# EAGLE board Mk4 Prototype (EAGLE 9.0.1), part 2 of 2
## Tracks (layer width: path | path; a pad name or v marks a point on that pad's centre or on a via) (continued)
GND  (via drill 0.3) (continued)
  Bottom 0.15: J2.32 56.55,38.25 | J2.31 57.05,38 | J2.30 57.55,38 | J2.29 58.05,38 | J2.28 58.55,38 | J2.27 59.05,38 | J2.26 59.55,38 | J2.25 60.05,38 | J2.24 60.55,38 | J2.23 61.05,38 | J2.22 61.55,38 | J2.21 62.05,38 | J2.20 62.55,38 | J2.19 63.05,38 | J2.18 63.55,38 | J2.17 64.05,38 | J2.16 64.55,38 | J2.15 65.05,38 | J2.14 65.55,38 | J2.13 66.05,38 | J2.12 66.55,38 | J2.11 67.05,38 | IC1.58 v53.4,56.8 | IC1.55 v53.4,55.6 | IC7.3 70.3,70.45 v70.5,70.65 | ANT2.3 106.59,69.4 v105.95,69.4 | v105.5,68.25 105.6,68.15 105.74,68.15 105.64,68.25 v105.5,68.25 | ANT2.2 105.85,67.9 v105.5,68.25 | ANT2.4 110.08,67.7 v110.55,67.7 | IC15.PAD v17.9,23.1 | IC15.PAD v16.7,23.1 | IC15.PAD v16.7,21.9 | IC15.PAD v17.9,21.9 | v16.7,24.3 17.3,24.9 v17.3,25.85 | v16.1,25.85 16.1,24.9 v15.5,24.3 15.55,24.35 | v19.1,24.3 19.1,25.35 v19.6,25.85 | v75.3,18.75 C102.2 76.05,19.5 76.3,19.75 76.3,20.75 76.05,21 U2.2 75.05,21 74.55,20.5 U2.4 | C104.2 83.3,8.7 v83.55,8.45
  Bottom 0.2: C13.1 62.4,43.85 IC1.10 | IC1.17 59.6,43.8 C12.1 v59.3,42.75 | IC1.48 50.85,52.8 C10.1 | IC1.114 68.95,52.4 C9.1 | IC1.80 59.6,62.05 59.77,62.23 | X4.4 7.67,21.43 v7.6,21.5 | X4.2 9.52,17.07 v9.6,17 | IC4.23 75.52,26.75 75.03,27.23 75.05,27.25 | 75.05,27.25 v75.05,27.5 | IC4.24 75.05,27.25 | IC4.18 76.8,23.25 v76.55,23 | IC4.9 v81.05,26.25 | IC8.17 40.3,21.5 v39.8,21 IC8.18 | J1.GND4 110.8,16.05
  Bottom 0.25: J2.50 47.55,37.45 v48.05,37.95 | J2.49 v48.05,37.95 | J2.48 48.55,37.45 v48.05,37.95 | J2.43 51.05,38 | J2.6 v69.55,35.5 | v61.8,40.75 61.8,41.62 C14.1 62.05,42.12 C13.1 | v49.8,53.1 C10.1 | v70.05,52.75 C9.1 | v59.8,63 C11.1 59.77,62.23 | C8.1 v61.55,64.25 | v48.55,57.25 R3.2 | C15.1 v59.55,64.25 | v69.3,8.25 S19.1 | v45.3,8.25 S20.1 | C19.1 v56.5,63 | C18.1 v51.9,63 | v65.3,65.25 C17.1 | v60.8,65.25 C16.1 | v61.05,68.75 61.97,68.75 X2.2 | v65.05,66.5 64.08,66.5 X2.4 | v26.05,30 C87.2 27.2,31.1 v27.3,31 | R71.2 v18.3,15 | v25,49 IC13.PAD v25.55,49.45 | C46.2 32.67,15.22
  Bottom 0.3: 71.25,71.8 v71.95,71.1 | v25.8,27 R70.2 | v8.05,30.25 C60.1 | v10.3,31 10.42,30.88 C86.2 | v90.3,43.25 C69.2 | v89.3,43.25 C66.2 | v90.3,49.75 C65.2 | C67.2 v89.3,49.75 | IC5.8 93.9,42.65 v94.05,42.5 | R40.2 v88.55,40.25 | R38.2 v88.55,34.25 | R39.2 v88.55,36.25 | IC5.13 95.9,48.65 v96.05,48.5 | IC5.21 104.7,48.65 v104.55,48.5 | Q1.2 88.45,30.15 R30.2 v87.55,30 | IC11.4 81.7,58.34 C78.1 v81.3,59.5 | v85.8,60 85.71,60.09 JP4.5 | C71.1 v95.8,61.5 | IC12.7 86.99,49.81 R55.1 v87.05,49 | v95.3,53 C50.1 | v98.8,54 98.3,53.5 C49.1 | C48.1 v101.3,54 | J1.GND3 105.3,25.77 v105.3,25 | 117.17,28.5 J1.GND2 117.3,29 v117.8,29.5 | 117.97,26 J1.C4 117.3,25.45 v117.3,25 | v118.3,17 118.17,17 J1.GND1 | v62.95,71.1 62.97,71.12 C20.1 | R7.2 65.3,70.45 v65.2,70.35 | C1.2 v59.8,70.55 | v101.05,16.75 R59.2 101.05,15.07 Q2.2 | IC5.31 109.7,37.15 v109.8,37.25 | C51.1 v114.55,13.5 | J1.C5 110.65,17.65 v110.8,17.5 110.8,16.05 | v102.8,17.5 103.03,17.27 104.05,17.27 J1.GND6 | v112.55,29.25 112.8,29.5 IC10.3 | C2.1 v70.05,47 | C7.1 v72.8,50.25 | C6.1 v72.8,51.5 | C70.1 v76.8,48.75 | Q8.4 Q8.EP2 | C28.1 v46.8,42.25 | IC2.28 32.37,42.25 v33.3,42.25 | C24.1 v29.3,54.25 | IC2.46 33.5,56.7 v33.55,56.75 | C27.1 v29.3,59 | IC2.54 33.4,63.1 v33.55,63.25 | IC2.52 v33.55,61.5 | C26.1 v46.05,63.75 | C22.1 v46.8,61.5 | IC2.6 42.7,59.1 v42.55,59.25 | C23.1 v46.8,56.75 | C25.1 v46.8,52.75 | IC2.41 33.6,52.7 v33.8,52.5 | R15.1 v46.8,23.25 | R17.2 v46.8,24.25 | R19.2 42.3,29.5 v42.55,29.75 | v25.8,40 C42.1 | v26.55,40 26.55,39.5 C42.1 | v25.05,40 25.05,39.5 C42.1 | IC2.12 42.6,54.3 v42.55,54.25 | R63.2 v7.8,35.45 | R64.2 v8.8,35.45 | J1.GND5 110.91,27.89 v111.3,27.5 | R51.2 v78.8,48.5 | v26.05,54 C58.2 | v102.55,48.5 102.5,48.55 IC5.19 102.5,51.2 v102.55,51.25
  Bottom 0.3: R61.2 29.75,15.5 v30,15.75 | IC4.25 v77.3,26
  Bottom 0.4: C89.2 21.9,28.5 v22.25,28.85 | v25.05,27.5 C61.2 | v25.8,25.75 C95.2 | C84.2 21.92,33.62 v22.05,33.5 | C84.2 v21.05,34.75 | v19.8,34.75 C85.2 C84.2 | C90.2 16.7,30.9 v17.3,31.5 17.2,31.4 | C88.2 v14.8,31.1 | v13.3,31.4 13.9,30.8 C44.2 | v28.3,22.25 C100.1 | v28.3,23.25 C101.1 | v26.05,18.75 C96.2 | C92.2 v23.8,21 | C59.1 v14.05,37.25 | C98.1 v10.75,21.5 | C94.2 v10.05,22.25 | C62.2 v10.05,23.25 | C99.1 v10.75,17 | R62.2 v11.8,15.5 | R65.2 v12.8,15.5 | R72.2 v13.8,13.75 | C97.2 v16.8,13.75 | C91.2 v15.8,13.75 | v26.3,28.75 C93.2 25.2,29.9 v25.3,30 | IC14.4 7.2,42.16 v7.05,42 | v26.05,16.75 R25.2 | v73.3,26.5 C21.1 | v38.05,18.5 38.65,18.5 C40.2 38.65,19.5 v38.05,19.5 | S18.2 59.2,9 v60.05,9 | Q8.EP2 74.2,37.35 v74.3,37.25 | v74.3,41.25 v74.3,41.24 IC6.4 | C41.2 36.67,29.62 v36.55,29.75 | C41.2 v35.55,28.75 | C41.2 35.67,29.75 v35.55,29.75 | C36.2 35.4,27.4 v35.3,27.5 | v34.05,24.25 C39.1 | 0.8,21.6 v0.8,21.75 ANT1.4 | ANT1.3 v0.8,16.75 | ANT1.2 2.05,17.7 v2.05,16.75 | C43.1 v26.05,13 | C43.1 25.55,13.75 v26.05,13.75 | C43.1 25.55,12.25 v26.05,12.25
  Bottom 0.5: v12.15,36.05 12.15,35.5 C63.2 11.15,35.5 v11.15,36.05
  Bottom 1: J5.1 80.85,14.8 C34.2 | C34.2 79.4,14.85 v79.3,14.75 | C34.2 v80.8,13.5 | v45.55,20 C35.2 44.45,18.85 v44.55,18.75
  other vias: 57.05,38.25 66.55,38.25 4.8,39.5 5.55,30.25 5.55,27.75 50.8,41.25 102.3,62.25 101.3,62.25 101.3,55.75 102.3,55.75 25.6,48.55 26.1,49 110.5,48.1 110.15,44.35 109.8,65.5 109.3,64 108.8,62.5 107.3,62.5 105.8,63 104.8,63.25 104.05,64.5 104.55,65.75 105.05,67.25 15.5,23.1 15.5,21.9 15.5,20.7 16.7,20.7 17.9,20.7 19.1,20.7 19.1,21.9 19.1,23.1 17.9,24.3 10.8,27.25 10.8,24.25 6.8,19.25 6.05,16.75 5.05,16.75 4.05,16.75 3.05,16.75 5.8,21.75 4.8,21.75 3.8,21.75 3,21.75 5.55,24.75 2.3,24.75 78.8,26 78.05,26.75 78.05,25.25 89.05,27.5 89.05,26.75 112.55,35.5 111.8,36.25 111.05,36.95 109.8,35 110.55,34.5 111.1,34 115.8,31.5 115.3,32.25 116.3,32.25 113.8,33.25 117.3,34.5 118.3,34.5 112.8,36.75 112.8,40.75 112.8,42.75 112.8,44.75 112.8,46.75 112.8,52.75 112.8,54.75 112.8,56.75 112.8,58.75 112.8,60.35 116.2,60.35 118.2,60.35 41.05,24 41.8,24 41.05,24.75 41.05,23.25 40.3,24 27.8,49 23.3,49 23.05,54.5 27.55,54 27.55,56.5 23.05,56.5 27.8,50.25 23.3,50.25 23.3,47.5 27.8,47.5 112.3,32.25 31.5,14.85 31.5,14.35 31.5,13.35 31.5,13.85 30.7,12.25 31.4,12.25 31.4,19.95 30.4,19.95 30.3,18.95 30.3,16.75 30.3,17.55 14.55,23.1 14.55,21.9 14.55,20.7 14.55,24.3 20.05,23.1 20.05,21.9 20.05,20.7 20.05,24.3 15.5,19.75 16.7,19.75 17.9,19.75 19.1,19.75 15.5,25.25 16.7,25.25 17.9,25.25 19.1,25.25 20.05,19.75 20.05,25.25 14.55,25.25 14.55,19.75 18.5,25.85 15,25.85 13.95,25.85 13.95,24.8 17.3,19.15 18.5,19.15 19.7,19.15 16.1,19.15 15,19.15 20.65,22.45 20.65,21.25 20.65,20.05 20.65,23.65 13.95,22.5 13.95,21.3 13.95,20.2 13.95,23.7 20.65,24.75 20.65,25.85 20.65,19.15 13.95,19.15 29.2,32.9 28.5,34.8 33.45,34.55
  pour GND@3 (isolate 0.254, rank 6): 0,60 0,9 arc31 31.8,0 34.5,0 arc90 37.3,2.8 arc-90 39.3,4.8 80.3,4.8 arc-90 82.3,2.8 arc90 85.1,0 87.8,0 arc31 119.6,9 119.6,35 113.3,35 113.3,60 119.6,60 arc64 113.05,67.75 arc24 59.8,78 arc24 6.55,67.75 arc55
  pour Bottom (rank 6): 67.05,36.9 67.05,38.25 66.8,38.5 56.8,38.5 56.55,38.25 56.55,36.9
  pour Bottom (isolate 0.254, rank 6): 0,60 0,16 10.8,11 11.8,32 7.8,32 6.3,33.5 6.3,59 11.3,64 11.8,64 92.8,65 92.8,49 104.8,49 104.8,30 119.6,30 119.6,35 113.3,35 113.3,60 119.6,60 arc64 113.05,67.75 arc24 59.8,78 arc24 6.55,67.75 arc55
  pour Bottom (rank 2, no thermals): 101.3,33 102.8,33 102.8,30.5 101.8,30.5 100.8,29.5 100.8,27.25 99.55,26 88.8,26 88.3,26.5 88.3,27.5 88.8,28 98.3,28 99.05,28.75 99.05,29.5 99.8,30.25 100.3,30.25 101.3,31.25
  pour Bottom (no thermals): 51.3,39.5 51.3,38.2 51.1,38 51,38 50.8,38.2 50.8,39.25 50.3,39.75 50.3,41.3 50.5,41.5 50.85,41.5 51.05,41.3 51.05,39.75
  pour Bottom: 22.8,47 28.3,47 28.3,57 22.8,57
  pour Bottom (no thermals): 37.2,27 37.2,28.1 37,28.3 37,29.8 36.55,30.25 35.55,30.25 35.05,29.75 35.05,27.25 35.3,27
  pour Bottom (no thermals): 29.75,11.8 29.75,19.65 30.25,20.15 31.35,20.15 31.85,19.65 31.85,16 32.25,15.6 33.6,15.6 33.65,15.55 33.65,14.9 33.55,14.8 31.7,14.8 31.7,11.8
  pour Top (rank 6): 0,39 0,16 arc34 36.8,7.5 37.3,7.5 37.3,39
GSM_ANT
  Bottom 0.4: L3.1 C72.2 110.5,36.05 IC5.32
I2C5_EXT_SCL
  Bottom 0.2: R24.1 92.6,16.7 88.3,16.7 82.5,22.5 82.5,33.8 76.1,40.2 72.8,40.2 72.42,40.58 72.42,46.34 72.1,46.66 72.1,47.5 70.4,49.2 69.2,49.2 68.8,49.6 IC1.121
  Bottom 0.3: R24.1 98.05,4.84 PCB.SCL
I2C5_EXT_SDA
  Bottom 0.2: R23.1 99.55,11.25 99.9,11.6 99.9,13.1 99.3,13.7 96.2,13.7 92.8,17.1 88.5,17.1 82.9,22.7 82.9,33.9 76.2,40.6 73,40.6 72.77,40.83 72.77,46.48 72.5,46.76 72.5,48 70.94,49.56 69.38,49.56 68.93,50 IC1.120
  Bottom 0.3: R23.1 99.05,10.54 PCB.SDA
I2C9_SCL  (via drill 0.3)
  Top 0.15: v53.7,47.1 53.3,46.7 v46.8,46.7 | v45.6,38.6 45.6,42.1 v46.8,43.3 | v63.8,26.1 63.8,26.3 62.8,27.3 52.6,27.3 v51.9,26.6 51.3,27.2 50.8,27.2 v50.2,26.6 | IC9.4 83.45,11.4 82.05,12.8 79.92,12.8 77,15.72 v77,20
  Bottom 0.15: IC8.5 41.8,26.75 42.35,27.3 45.7,27.3 46.6,26.4 50,26.4 v50.2,26.6 | IC4.19 74.55,24.75 | U2.1 76.05,21.5 76.07,21.52 | 76.07,21.52 76.3,21.75 76.3,22 74.55,23.75 74.55,24.75 | 74.55,24.75 71.55,24.75 70.2,26.1 v63.8,26.1 | v53.7,47.1 53.42,46.83 53,46.83 52.98,46.8 IC1.33 | v46.8,43.3 v46.8,46.7 46.85,46.75 R22.1 | v45.6,38.6 46.5,37.7 46.5,35.9 51.5,30.9 51.5,27 v51.9,26.6 | v77,20 77,20.6 76.07,21.52
I2C9_SDA  (via drill 0.3)
  Top 0.15: v71.8,24 v71.8,25.5 | v53.6,47.85 52.75,47 47.39,47 47.17,47.23 46.32,47.23 46.32,47.22 v45.8,46.7 | v45.8,43.3 44.8,42.3 v44.8,38.6 | v62.38,26.7 52.92,26.7 52.12,25.9 51.4,25.9 51.1,26.2 v51.1,26.6 | IC9.6 82.15,12.05 81.7,12.5 79.8,12.5 72.6,19.7 v72.6,20
  Bottom 0.15: IC8.6 42.3,26.75 42.55,27 45.58,27 46.48,26.1 49.7,26.1 49.9,25.9 50.8,25.9 51.1,26.2 v51.1,26.6 51.2,26.7 51.2,30.75 46.2,35.75 46.2,37.1 44.8,38.5 v44.8,38.6 | IC4.20 74.72,25.25 74.69,25.23 72.08,25.23 v71.8,25.5 70.9,26.4 64.3,26.4 64,26.7 v62.38,26.7 | U2.6 73.55,21.5 72.6,22.45 | v71.8,24 71.8,23.25 72.6,22.45 | IC1.34 52.95,47.2 v53.6,47.85 | v45.8,43.3 v45.8,46.7 45.9,46.8 45.9,47.7 R21.1 | v72.6,20 72.6,22.45
JOY_CEN  (via drill 0.3)
  Top 0.15: SW1.CTR 20.94,38.66 22.32,38.66 22.78,38.2 23.3,38.2 23.76,38.66 24.19,38.66 24.65,38.2 28.1,38.2 29.32,36.98 30.16,36.98 30.66,36.48 31.34,36.48 31.87,37 45.9,37 46.55,37.65 46.55,40.65 48.6,42.7 53.1,42.7 53.9,43.5 53.9,44.57 54.93,45.6 56.92,45.6 57.7,46.38 57.7,47.3 v59,48.6
  Bottom 0.15: v59,48.6 58.5,49.1 58.5,54.5 56.4,56.6 IC1.72
JOY_DOWN  (via drill 0.3)
  Top 0.15: v59.8,47.8 59.8,47 57.5,44.7 55.3,44.7 54.8,44.2 54.8,42.95 53.65,41.8 49.12,41.8 47.45,40.13 47.45,37.05 46.5,36.1 32.24,36.1 31.71,35.58 30.28,35.58 30.16,35.7 24.8,35.7 23.8,34.7 23.1,34.7 SW1.D
  Bottom 0.15: v59.8,47.8 59.9,47.9 59.9,49.02 59.1,49.82 59.1,55.1 57.2,57 IC1.74
JOY_LEFT  (via drill 0.3)
  Top 0.15: SW1.C 19.14,38.66 19.67,38.66 19.97,38.36 22.2,38.36 22.65,37.9 23.42,37.9 23.88,38.36 24.07,38.36 24.53,37.9 27.98,37.9 29.2,36.67 30.03,36.67 30.53,36.17 31.47,36.17 31.99,36.7 46.1,36.7 46.85,37.45 46.85,40.45 48.8,42.4 53.3,42.4 54.2,43.3 54.2,44.45 55.05,45.3 57.05,45.3 58,46.25 58,46.8 v59,47.8
  Bottom 0.15: IC1.73 56.8,56.8 58.8,54.8 58.8,49.7 59.6,48.9 59.6,48.4 v59,47.8
JOY_RIGHT  (via drill 0.3)
  Top 0.15: SW1.B 25.4,36 30.28,36 30.41,35.88 31.59,35.88 32.11,36.4 46.3,36.4 47.15,37.25 47.15,40.25 49,42.1 53.5,42.1 54.5,43.1 54.5,44.32 55.18,45 57.17,45 58.3,46.13 58.3,46.62 58.68,47 v59,47 | v61.8,58.8 61.9,58.7 v63.6,58.7
  Bottom 0.15: v59,47 59.8,47 60.4,47.6 60.4,49 59.4,50 59.4,53.1 61.8,55.5 v61.8,58.8 | IC1.91 64,59.79 64.08,59.72 64.08,59.17 v63.6,58.7
JOY_UP  (via drill 0.3)
  Top 0.15: SW1.A 21.09,40.31 21.09,39.99 21.59,39.49 21.91,39.49 22.8,38.61 23.28,38.61 23.63,38.96 24.32,38.96 24.78,38.5 28.3,38.5 29.52,37.27 30.28,37.27 30.78,36.77 31.22,36.77 31.74,37.3 45.75,37.3 46.25,37.8 46.25,40.82 48.43,43 52.9,43 53.6,43.7 53.6,44.7 54.8,45.9 56.8,45.9 57.4,46.5 57.4,47.8 v58.2,48.6
  Bottom 0.15: IC1.71 56,56.4 58.2,54.2 v58.2,48.6
LCD_!RST  (via drill 0.3)
  Top 0.15: v65.4,53.6 65.4,51.5 69.38,47.52 70.27,47.52 70.89,46.9 v71.4,46.9
  Bottom 0.15: J2.10 67.55,38.4 67.55,38.5 67.55,39.7 68.25,40.4 71.8,40.4 72.1,40.7 72.1,46.2 v71.4,46.9 | IC1.111 v65.4,53.6
LCD_DCX
  Bottom 0.15: J2.36 54.55,38.3 55.3,39.05 55.3,41.9 56.6,43.2 57.15,43.2 58.4,44.45 IC1.20
LCD_TEAR  (via drill 0.3)
  Top 0.15: v52.95,38.5 52.95,40.6 53.85,41.5 54.8,41.5 55.4,42.1 v55.4,43
  Bottom 0.15: J2.39 53.05,38.4 v52.95,38.5 | IC1.21 58,44.47 57.03,43.5 56.48,43.5 55.98,43 v55.4,43
LED1
  Bottom 0.15: R12.2 61.07,70.27 59.8,69 59.8,65.3 60.8,64.3 60.8,62.2 61.07,61.92 61.52,61.92 62,61.44 IC1.86
LED1_R  (via drill 0.3)
  Top 0.25: LED3.A v61.07,73.75
  Bottom 0.3: R12.1 v61.07,73.75
LED2
  Bottom 0.15: IC1.85 61.6,61.42 61.39,61.62 60.88,61.62 60.5,62 60.5,64.15 59.5,65.15 59.5,69 58.53,69.97 R14.2
LED2_R  (via drill 0.3)
  Top 0.25: LED4.A v58.53,73.75
  Bottom 0.25: v58.53,73.75 R14.1
LED5_R
  Top 0.5: R11.1 28.38,11.92 30.3,10 32.3,10 32.38,9.92 32.45,9.92 LED5.A
LEDK
  pour Bottom (no thermals): 69.1,39.7 69.1,39.3 72.4,39.3 72.5,39.3 73.15,38.65 73.35,38.65 75.35,38.65 75.35,39.5 72.7,39.5 72.5,39.7
LEDK1
  Bottom 0.25: J2.2 71.55,37.75 R47.2
LEDK2
  Bottom 0.25: J2.3 71.05,38.25 R48.2
LEDK3
  Bottom 0.25: J2.4 70.55,38.25 R49.2
LEDK4
  Bottom 0.25: J2.5 70.05,37.75 R44.2
MIC_MUX_N
  Bottom 0.2: IC12.11 90.8,58.5 90.3,59 88.55,59 88.26,58.71 IC12.9 88.26,55.04 88.8,54.5 90.8,54.5 91.45,53.85 91.45,50.22 91.38,50.15 91.38,49.18 91.98,48.58 93.73,48.58 95.12,47.18 95.12,45.32 94.23,44.42 93.55,44.42 93.12,44.85 IC5.10
MIC_MUX_P
  Bottom 0.2: IC12.1 94.61,50.31 94.3,50 92.55,50 92.07,50.48 IC12.3 92.07,50.34 91.72,50 91.72,49.32 92.12,48.92 93.87,48.92 95.47,47.32 95.47,45.18 94.37,44.08 93.55,44.08 93.22,43.75 IC5.9
MIC_N
  Bottom 0.2: C56.2 C53.1 | C52.2 C55.1 | C52.2 C56.2 | U4.- 104.88,59.75 104.3,59.17 102.62,59.17 C52.2 | C56.2 100.97,59.17 99.87,59.17 98.97,60.07 98.97,63.5 99.21,63.74 S22.6
MIC_P
  Bottom 0.2: C52.1 C54.1 | C56.1 C57.1 | C52.1 C56.1 | U4.+ 104.88,58.25 104.3,58.83 102.65,58.83 102.32,58.5 C52.1 | C56.1 100.97,58.83 99.73,58.83 98.62,59.93 98.62,63.5 96.65,65.48 S22.3
MIC_PWM_AMP
  Bottom 0.15: IC11.2 79.3,56.75 79.3,57
  Bottom 0.2: C81.2 C80.2 79.3,55 79.16,55.13 IC11.2 IC11.1 | 79.3,56.94 79.3,57 C79.1
MIC_PWM_AMP_+
  Bottom 0.2: IC11.3 80.44,58.62 C78.2 R52.2
MIC_PWM_N
  Bottom 0.2: IC12.8 86.99,55.69 86.3,55 R54.1 C80.1
MIC_PWM_P
  Bottom 0.2: IC12.4 90.8,53.5 90.3,54 R54.2 C81.1
MIC_PWM_R
  Bottom 0.2: R53.1 C79.2 R52.1
MIC_SWITCHED_N
  Bottom 0.2: IC12.10 89.53,55.27 89.8,55 93.55,55 93.8,54.75 95.8,54.75 95.88,54.67 96.48,54.67 97.38,55.57 97.38,62.18 96.23,63.33 94.48,63.33 93.38,64.43 93.38,65.42 93.3,65.5 93.3,67 95.55,69.25 97.05,69.25 97.3,69 97.8,69 98.05,68.75 98.55,68.75 101.17,66.13 S22.5 102.28,66.5
MIC_SWITCHED_P
  Bottom 0.2: IC12.2 93.34,53.79 93.8,54.25 95.8,54.25 95.88,54.33 96.62,54.33 97.72,55.43 97.72,62.32 96.37,63.67 94.62,63.67 93.72,64.57 93.72,65.42 93.8,65.5 93.8,66.25 95.05,67.5 96.58,67.5 S22.2
MUX_A  (via drill 0.3)
  Top 0.15: v92.3,59.5 89.8,57 69.75,57 v68.95,56.2
  Bottom 0.15: IC1.105 68.75,56 v68.95,56.2
  Bottom 0.2: IC12.12 92.07,59.27 v92.3,59.5 R56.1 93.34,59.29 IC12.13
MUX_B  (via drill 0.3)
  Top 0.15: v88.05,49 87.05,50 80.8,50 79.3,51.5 79.3,55.2 79.3,55.3 79.3,56.1 78.7,56.7 70.4,56.7 v69.7,56
  Bottom 0.15: R55.2 v88.05,49 | IC1.106 69.3,55.6 v69.7,56
  Bottom 0.2: IC12.6 88.26,49.96 R55.2 88.52,49.75 89.07,50.3 89.1,50.3 89.53,50.73 IC12.5
N$1
  cutout GND@3 (no thermals): 21.7,28.9 21.7,28.85 21.7,28.9 22.04,29.24 arc-90 22.46,29.24 22.64,29.06 arc-90 22.64,28.64 19.95,25.95 19.95,25.8 arc-90 19.65,25.5 19.55,25.5 arc-90 19.25,25.8 19.25,26.4 21.7,28.85
N$2
  cutout GND@3 (no thermals): 16.9,30.5 16.9,26.8 17.65,26.05 17.65,25.75 arc-90 17.35,25.45 17.25,25.45 arc-90 16.95,25.75 16.2,26.5 16.2,31 17.09,31.89 arc-90 17.51,31.89 17.69,31.71 arc-90 17.69,31.29
N$3
  cutout GND@3 (no thermals): 15.9,30.6 15.9,26.6 16.45,26.05 16.45,25.75 arc-90 16.15,25.45 16.05,25.45 arc-90 15.75,25.75 15.2,26.3 15.2,30.1 14.41,30.89 arc-90 14.41,31.31 14.59,31.49 arc-90 15.01,31.49
NETLIGHT_R
  Bottom 0.15: IC5.41 97,31.2 96.8,31 90.55,31 R42.2
OSC0
  Bottom 0.15: X2.1 62.55,66.17 C16.2 62.8,65 IC1.88
OSC1
  Bottom 0.15: IC1.89 63.2,62.9 R6.1
OSC1_R
  Bottom 0.15: X2.3 63.05,67.97 63.05,65.75 C17.2 R6.2
POWER_SWITCH  (via drill 0.3)
  Top 0.15: v61.05,9 60.52,9.53 59.83,9.53 59.81,9.5 38.1,9.5 36.82,10.78 36.82,13.28 v37.55,14
  Bottom 0.15: Q3.4 38.1,14.2 R13.1 v37.55,14 | S18.3 61.2,8.85 v61.05,9
PWM0_LCD_BLIGHT  (via drill 0.3)
  Top 0.15: v74.9,36.5 74.9,45.8 74.5,46.2 69.1,46.2 68.6,46.2 68.37,46.2 64.67,49.9 63.13,49.9 63.03,49.8 62.52,49.8 62.22,50.1 60.33,50.1 60.03,49.8 55.7,49.8 v55,49.1
  Bottom 0.15: Q8.3 75.22,36.82 v74.9,36.5 | v55,49.1 53.7,50.4 IC1.42
PWM3_MIC_PWM  (via drill 0.3)
  Top 0.15: v75.5,54.3 74.9,54.9 64.6,54.9 64,55.5 64,57.6 63.57,58.02 61.02,58.02 59,56 59,54.72 58.8,54.52 58.8,52.2 58.3,51.7 54,51.7 v53.8,51.9
  Bottom 0.15: IC1.45 53.5,51.6 v53.8,51.9 | R53.2 75.77,58.23 75.38,58.23 74.9,57.74 74.9,54.9 v75.5,54.3
PWR_KEY_FET
  Bottom 0.15: IC5.39 99.2,30.15 98.8,29.75 91.47,29.75 Q1.3
RBIAS+
  Bottom 0.2: IC1.59 50.35,57.2 R3.1
SDRAM_!CAS  (via drill 0.3)
  Top 0.15: v60.3,56 59.8,55.5 59.8,54.67 59.4,54.27 59.4,51.57 58.83,51 45.55,51 v44.8,50.25
  Bottom 0.15: IC2.17 44.25,50.3 44.3,50.25 v44.8,50.25 | IC1.83 60.8,56.5 v60.3,56
SDRAM_!CS  (via drill 0.3)
  Top 0.15: v44.8,48.75 46.25,50.2 50.16,50.2 50.23,50.27 50.67,50.27 50.94,50 54.73,50 55.13,50.4 59.08,50.4 60,51.32 60,54.02 62.28,56.3 62.85,56.3 v63.3,56.75
  Bottom 0.15: IC2.19 43.73,48.75 v44.8,48.75 | IC1.103 66.35,56.8 66.3,56.75 v63.3,56.75
SDRAM_!RAS  (via drill 0.3)
  Top 0.15: v61.05,56 60.3,55.25 60.3,54.75 59.7,54.15 59.7,51.45 58.95,50.7 55.01,50.7 54.81,50.5 50.87,50.5 50.79,50.58 50.11,50.58 50.03,50.5 45.8,50.5 v44.8,49.5
  Bottom 0.15: IC2.18 v44.8,49.5 | IC1.84 61.2,56.15 v61.05,56
SDRAM_!WE  (via drill 0.3)
  Top 0.15: v44.8,51 45.3,51.5 53.46,51.5 53.58,51.38 58.67,51.38 59.1,51.8 59.1,54.4 59.3,54.6 59.3,55.88 60.92,57.5 v63.3,57.5
  Bottom 0.15: IC2.16 44.2,51.1 44.3,51 v44.8,51 | IC1.92 64.4,58.6 v63.3,57.5
SDRAM_A0  (via drill 0.3)
  Top 0.15: v38.3,61.5 38.3,60.99 38.27,60.97 38.27,56.27 38.32,56.22 38.32,47.27 38.27,47.22 38.27,46.52 38.32,46.47 38.32,46.03 38.3,46.01 v38.3,45.5 | v44.8,45.5 45.4,44.9 51.5,44.9 v52.1,45.5
  GND@3 0.15: v38.3,61.5 38.27,61.48
  Bottom 0.15: IC2.2 39.1,62.3 v38.3,61.5 | IC1.29 54.8,46.04 54.32,46.52 53.55,46.52 | v44.8,45.5 IC2.23 v38.3,45.5 | 53.55,46.52 | 53.55,46.52 53.12,46.52 v52.1,45.5
SDRAM_A1  (via drill 0.3)
  Top 0.15: v41.8,44.75 41.82,44.77 41.82,57.95 41.7,58.08 41.7,60.1 41.3,60.5 v41.05,60.5 | v44.8,44.75 44.95,44.6 51.95,44.6 v52.1,44.75
  Bottom 0.15: v41.05,60.5 41.25,60.7 IC2.4 | IC1.30 54.4,46.02 54.19,46.23 53.27,46.23 52.8,45.75 52.8,45 52.55,44.75 v52.1,44.75 | v44.8,44.75 44.3,44.75 44.25,44.7 IC2.24 43.1,44.7 43.05,44.75 v41.8,44.75
SDRAM_A2  (via drill 0.3)
  Top 0.15: v41,59.75 41.32,59.42 41.32,46.4 41.27,46.35 41.27,44.02 v41.3,44 | v44.8,44 45.1,44.3 51.8,44.3 v52.1,44
  Bottom 0.15: v41,59.75 41.15,59.9 IC2.5 | v44.8,44 44.3,44 44.2,43.9 IC2.25 43.15,43.9 43.05,44 v41.3,44 | IC1.31 54,44.05 53.3,43.35 52.35,43.35 52.1,43.6 v52.1,44 v52.1,43.99
SDRAM_A3  (via drill 0.3)
  Top 0.15: v40.8,58.25 40.77,58.23 40.77,43.27 v40.8,43.25 | v44.8,43.25 45.55,44 51.35,44 52,43.35 52.35,43.35 v53,44
  Bottom 0.15: v44.8,43.25 44.3,43.25 44.15,43.1 IC2.26 43.2,43.1 43.05,43.25 v40.8,43.25 | v53,44 53.35,44 53.6,44.25 IC1.32 | v40.8,58.25 41.12,58.25 41.17,58.2 42.34,58.2 42.56,57.98 43,57.98 43.32,58.3 IC2.7
SDRAM_A4  (via drill 0.3)
  Top 0.15: v40.05,57.5 v40.05,43 | v44.8,57.5 45.55,56.75 45.55,56.25 46.3,55.5 52.05,55.5 52.67,56.12 53.62,56.12 53.99,55.75 55.3,55.75 v56.05,55
  Bottom 0.15: IC1.22 57.6,53.45 v56.05,55 | v40.05,57.5 IC2.8 v44.8,57.5 | IC2.29 32.95,43.1 33.05,43 v40.05,43
SDRAM_A5  (via drill 0.3)
  Top 0.15: v37.3,56.75 37.27,56.73 37.27,55.52 37.38,55.42 37.38,51.52 37.67,51.22 37.67,50.28 37.47,50.08 37.47,47.42 37.27,47.22 37.27,45.4 37.32,45.35 37.32,44.02 v37.3,44 | v44.8,56 45.67,55.12 51.27,55.12 51.39,55 55.05,55 v56.05,54
  Bottom 0.15: IC1.23 57.2,52.85 v56.05,54 | v37.3,56.75 37.8,56.75 38.55,56 42.8,56 42.9,55.9 IC2.10 44.2,55.9 44.3,56 v44.8,56 | IC2.30 32.95,43.9 33.05,44 v37.3,44
SDRAM_A6  (via drill 0.3)
  Top 0.15: v36.8,55.25 36.8,53.74 36.82,53.72 36.82,51.64 37.38,51.09 37.38,50.41 37.17,50.2 37.17,49.66 36.82,49.31 36.82,45.28 36.8,45.26 v36.8,44.75 | v44.8,55.25 45.55,54.5 46.8,54.5 47.12,54.83 51.14,54.83 51.27,54.7 54.6,54.7 v56.05,53.25
  Bottom 0.15: IC1.24 56.8,52.5 56.55,52.75 56.5,52.8 v56.05,53.25 | v36.8,55.25 42.8,55.25 42.95,55.1 IC2.11 44.15,55.1 44.3,55.25 v44.8,55.25 | IC2.31 33,44.7 33.05,44.75 v36.8,44.75
SDRAM_A7  (via drill 0.3)
  Top 0.15: v36.3,45.5 36.3,49.21 36.87,49.78 36.87,50.33 37.07,50.53 37.07,50.97 36.3,51.74 v36.3,53.5 | v56.1,52.3 54,54.4 51.14,54.4 51.02,54.52 47.25,54.52 46.92,54.2 45.5,54.2 v44.8,53.5
  Bottom 0.15: v44.8,53.5 IC2.13 v36.3,53.5 | IC2.32 v36.3,45.5 | IC1.25 56.4,47.26 56.42,47.28 56.42,51.98 v56.1,52.3
SDRAM_A8  (via drill 0.3)
  Top 0.15: v34.05,53.5 34.05,52.99 34.36,52.68 34.36,50.03 33.95,49.61 33.95,49.29 34.07,49.16 34.07,48.53 34.05,48.51 v34.05,46.25 36.47,43.83 36.47,43.66 37.63,42.5 39.38,42.5 39.71,42.17 40.39,42.17 40.64,42.42 41.14,42.42 41.72,43 43.3,43 43.8,43.5 43.8,46.5 44.3,47 44.38,47 45.2,47.83 47.82,47.83 47.84,47.8 49.25,47.8 v50.45,49
  Bottom 0.15: IC2.42 v34.05,53.5 | IC2.33 33,46.3 33.05,46.25 v34.05,46.25 | IC1.40 51.05,49.6 v50.45,49
SDRAM_A9  (via drill 0.3)
  Top 0.15: v31.05,47.25 31.05,48.76 30.46,49.34 30.46,54.66 v31.05,55.25 | v35.55,47 35.55,45.17 36.77,43.95 36.77,43.78 37.56,43 39.31,43 39.83,42.48 40.27,42.48 40.52,42.73 41.02,42.73 41.59,43.3 42.6,43.3 43.3,44 43.3,46.5 44.4,47.6 44.55,47.6 45.08,48.12 47.94,48.12 47.96,48.1 48.8,48.1 v50.45,49.75
  Bottom 0.15: IC2.44 31.95,55.1 31.8,55.25 v31.05,55.25 | v31.05,47.25 31.8,47.25 31.95,47.1 IC2.34 32.95,47.1 33.05,47 v35.55,47 | IC1.41 50.7,50 v50.45,49.75
SDRAM_A10  (via drill 0.3)
  Top 0.15: v37.8,46.25 37.8,49.98 37.97,50.16 37.97,51.34 37.8,51.52 v37.8,56 | v54.85,47.8 54.22,47.17 54.22,46.88 53.92,46.58 53.62,46.58 53.22,46.17 46.59,46.17 46.48,46.17 44.88,46.17 v44.8,46.25
  Bottom 0.15: IC2.45 33.2,55.9 33.3,56 v37.8,56 | v44.8,46.25 44.3,46.25 44.25,46.3 IC2.22 43.1,46.3 43.05,46.25 v37.8,46.25 | IC1.50 53.1,53.6 53.2,53.7 54.3,53.7 55.3,52.7 55.3,52.05 56.1,51.25 56.1,48.8 55.57,48.27 55.32,48.27 v54.85,47.8
SDRAM_A11  (via drill 0.3)
  Top 0.15: v30.3,57.5 30.3,56 29.8,55.5 29.8,54.49 29.82,54.47 29.82,54.03 29.77,53.98 29.77,48.53 29.8,48.51 v29.8,48 | v42.55,48.75 44.27,50.48 44.27,52.98 45.12,52.98 46.05,53.9 47.05,53.9 47.17,54.02 50.02,54.02 51.05,53 v53.55,53
  Bottom 0.15: IC2.47 v30.3,57.5 | v29.8,48 31.8,48 31.9,47.9 IC2.35 32.95,47.9 33.05,48 38.3,48 39.05,48.75 v42.55,48.75 | IC1.49 53.35,53.2 v53.55,53
SDRAM_A12  (via drill 0.3)
  Top 0.15: v30.3,48.75 30.3,49.08 30.16,49.22 30.16,55.36 31.05,56.25 v31.05,58.25 34.82,62.02 36.9,62.02 37.2,62.33 46.03,62.33 46.33,62.62 47.27,62.62 47.72,62.17 57.06,62.17 v57.27,61.97
  Bottom 0.15: IC2.48 31.85,58.3 31.8,58.25 v31.05,58.25 | IC2.36 31.85,48.7 31.8,48.75 v30.3,48.75 | v57.27,61.97 57.6,61.64 IC1.75